# EasyEDA Pro project FOX_HTOL_1.0.eprj, board PCB1 (continued)
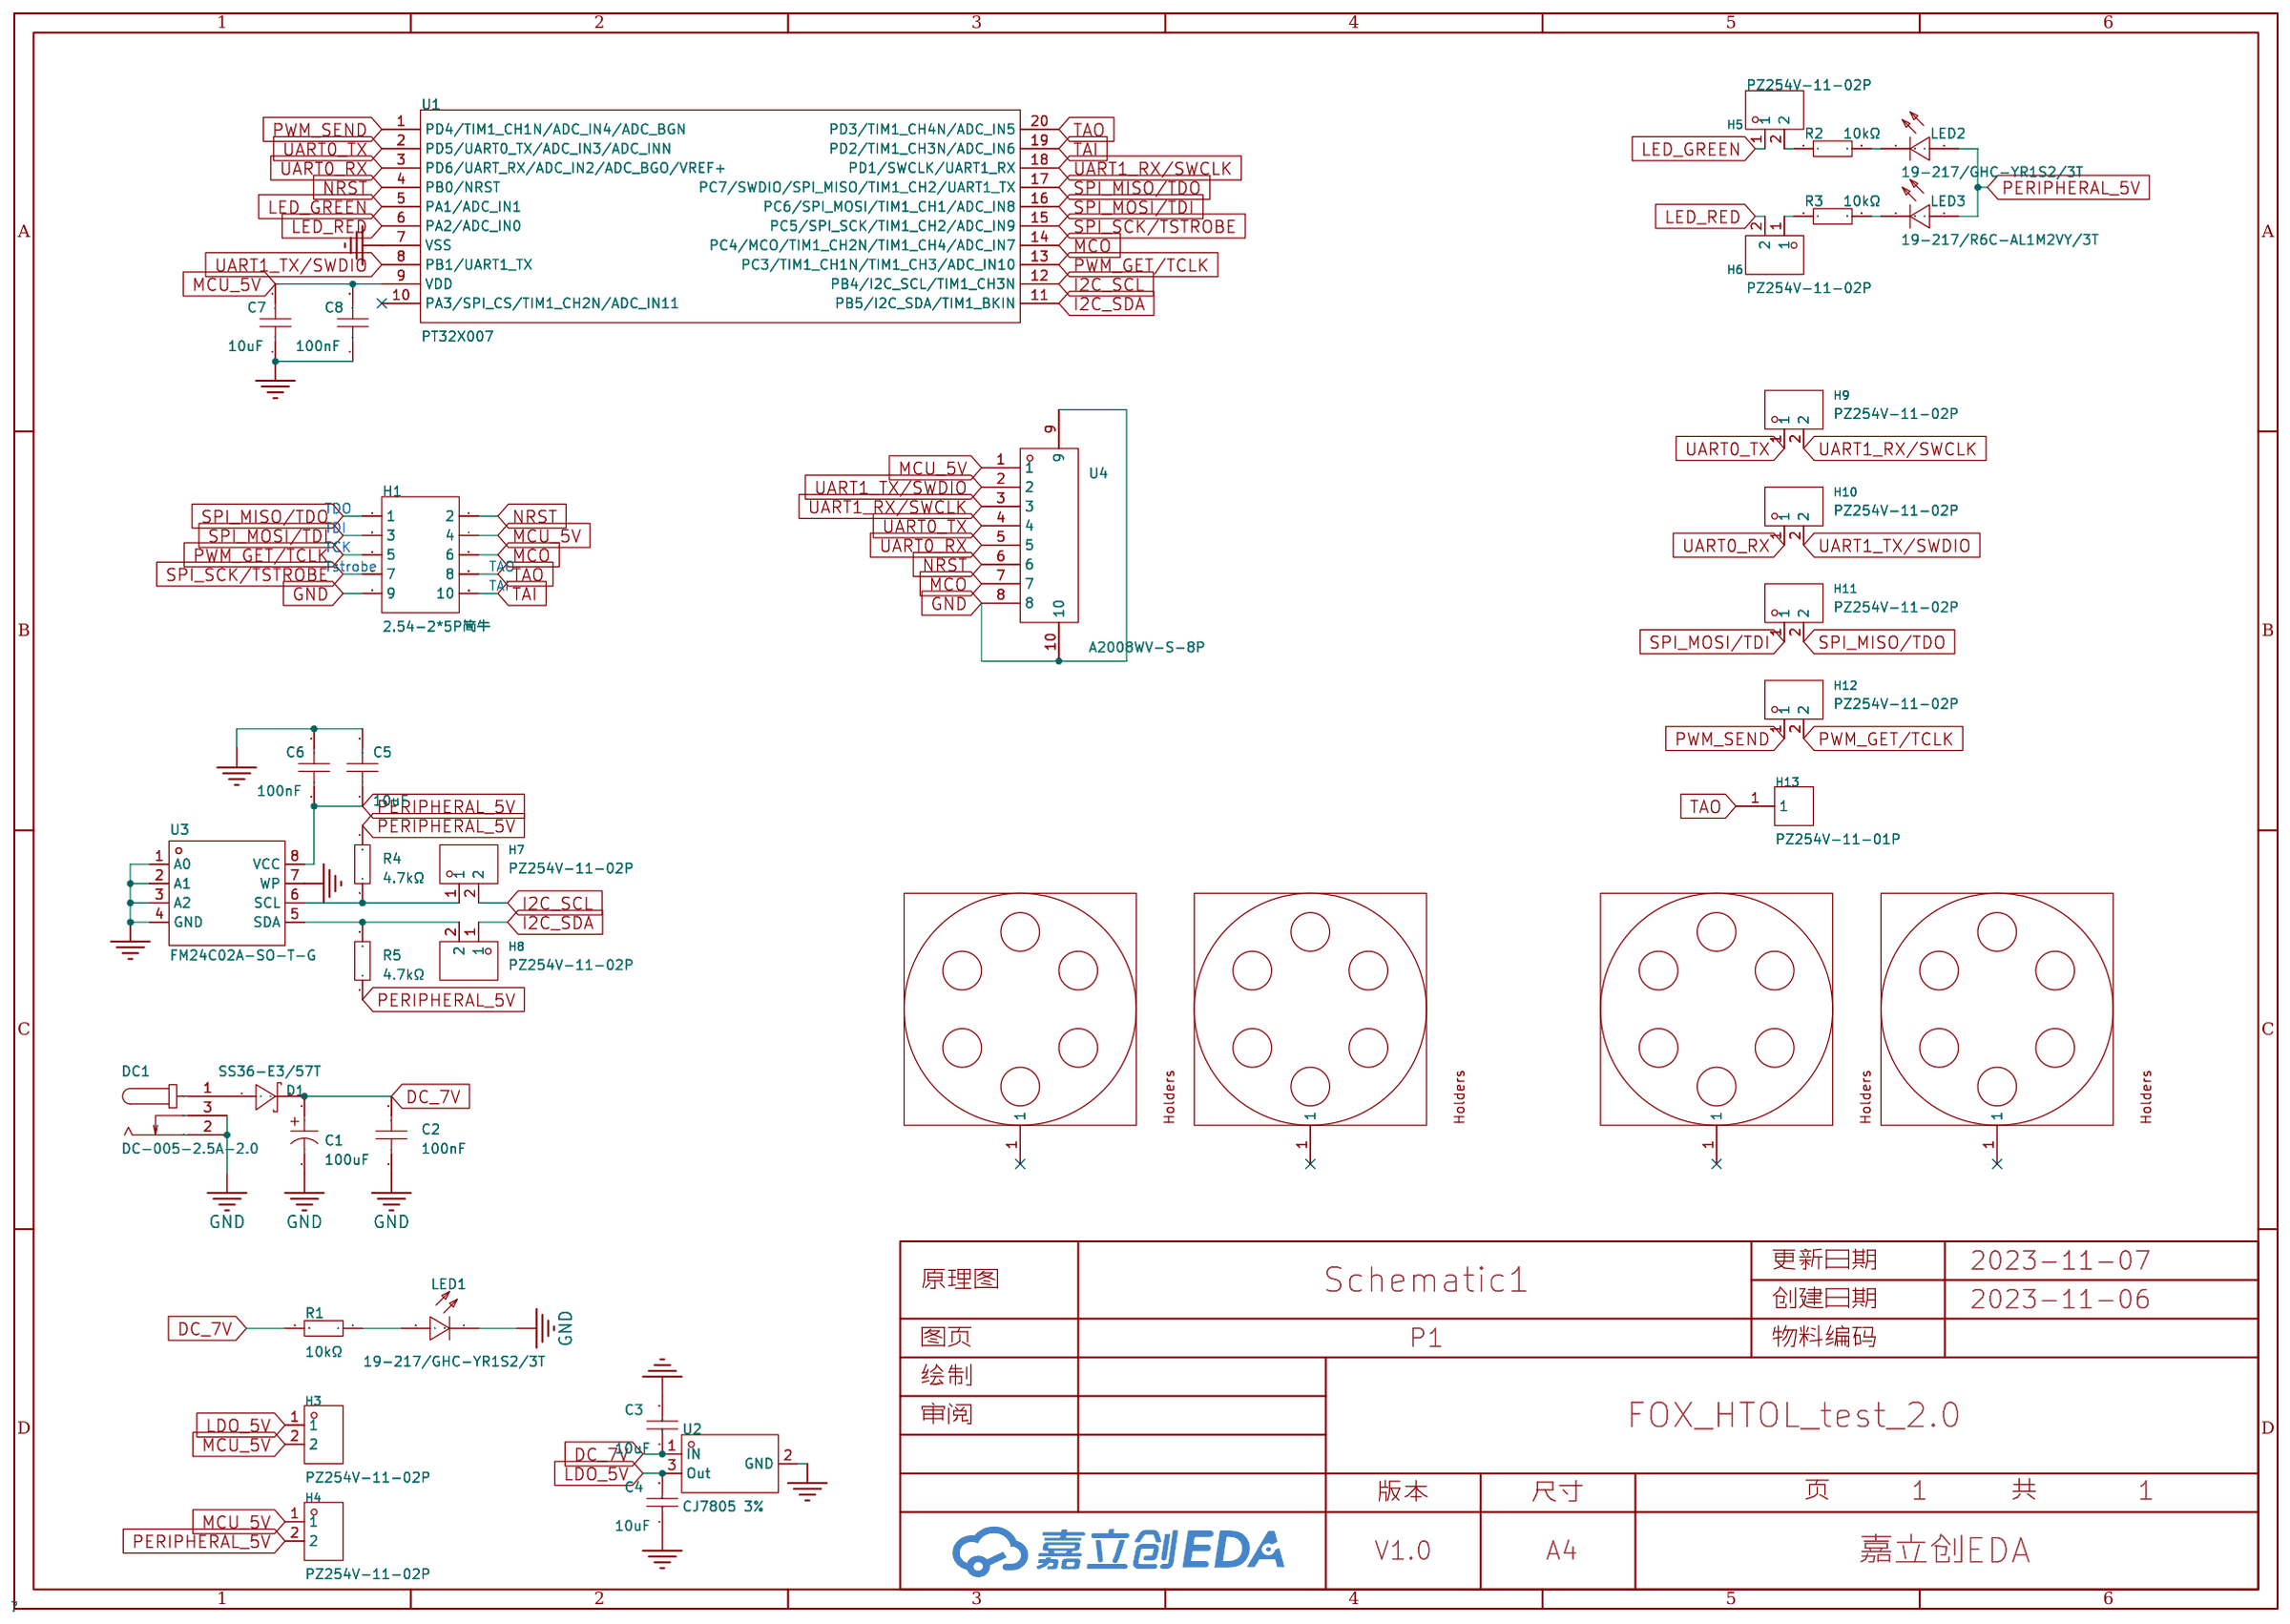
[diagram p0: schematic sheet]
## Routing (per net, layer and track width the routed paths; a pad name or vN(x,y) marks a point on that pad's centre or on a via; arc(x,y) is an arc through that point) (continued)
LED_RED: length 353.3
  Top Layer w0.254: U1#16.6 126.24,183.58 125.66,184.16 125.66,185.43 125.15,185.94 H6#14.2 ; H6#3.2 86.74,89.57 87.25,89.06 87.25,87.79 87.83,87.21 U1#6.6 ; U1#28.6 49.41,87.21 48.83,87.79 48.83,89.06 48.32,89.57 H6#25.2 ; H6#31.2 48.32,250.19 48.83,249.68 48.83,248.41 49.41,247.83 56.63,247.83 ; H6#4.2 86.74,218.07 87.25,217.56 87.25,216.29 87.83,215.71 U1#5.6 ; U1#18.6 10.99,151.46 10.41,152.04 10.41,153.31 9.91,153.82 H6#18.2 ; H6#23.2 48.32,121.69 48.83,121.18 48.83,119.91 49.41,119.33 56.63,119.33 ; U1#20.6 10.99,87.21 10.41,87.79 10.41,89.06 9.91,89.57 H6#20.2 ; 18.21,119.33 10.99,119.33 10.41,119.91 10.41,121.18 9.91,121.69 H6#22.2 ; H6#5.2 86.74,153.82 87.25,153.31 87.25,152.04 87.83,151.46 U1#9.6 ; H6#19.2 9.91,25.32 10.41,24.81 10.41,23.54 10.99,22.96 U1#19.6 ; U1#17.6 126.24,151.46 125.66,152.04 125.66,153.31 125.15,153.82 H6#13.2 ; H6#24.2 48.32,25.32 48.83,24.81 48.83,23.54 49.41,22.96 U1#26.6 ; 95.04,247.83 87.83,247.83 87.25,248.41 87.25,249.68 86.74,250.19 H6#8.2 ; H6#21.2 9.91,57.44 10.41,56.94 10.41,55.67 10.99,55.09 U1#21.6 ; U1#23.6 10.99,215.71 10.41,216.29 10.41,217.56 9.91,218.07 H6#26.2 ; U1#30.6 49.41,183.58 48.83,184.16 48.83,185.43 48.32,185.94 H6#29.2 ; U1#12.6 126.24,22.96 125.66,23.54 125.66,24.81 125.15,25.32 H6#10.2 ; U1#11.6 126.24,55.09 125.66,55.67 125.66,56.94 125.15,57.44 H6#15.2 ; U1#3.6 87.83,55.09 87.25,55.67 87.25,56.94 86.74,57.44 H6#7.2 ; U1#25.6 49.41,55.09 48.83,55.67 48.83,56.94 48.32,57.44 H6#30.2 ; U1#14.6 126.24,87.21 125.66,87.79 125.66,89.06 125.15,89.57 H6#11.2 ; 133.46,247.83 126.24,247.83 125.66,248.41 125.66,249.68 125.15,250.19 H6#16.2 ; H6#32.2 9.91,250.19 10.41,249.68 10.41,248.41 10.99,247.83 18.21,247.83 ; H6#12.2 125.15,218.07 125.66,217.56 125.66,216.29 126.24,215.71 U1#13.6 ; 95.04,119.33 87.83,119.33 87.25,119.91 87.25,121.18 86.74,121.69 H6.2 ; H6#27.2 48.32,218.07 48.83,217.56 48.83,216.29 49.41,215.71 U1#27.6 ; 133.46,119.33 126.24,119.33 125.66,119.91 125.66,121.18 125.15,121.69 H6#9.2 ; U1#4.6 87.83,22.96 87.25,23.54 87.25,24.81 86.74,25.32 H6#2.2 ; U1#31.6 10.99,183.58 10.41,184.16 10.41,185.43 9.91,185.94 H6#17.2 ; U1#32.6 49.41,151.46 48.83,152.04 48.83,153.31 48.32,153.82 H6#28.2 ; U1#8.6 87.83,183.58 87.25,184.16 87.25,185.43 86.74,185.94 H6#6.2
MCO: length 1673.7
  Top Layer w0.254: 62.37,247.18 63.65,247.18 v1(64.58,246.25) ; v1(64.58,214.13) 63.65,215.06 U1#27.14 ; v1(115.39,150.21) 115.34,150.26 115.31,150.26 ; U1#28.14 63.65,86.56 v1(64.58,85.63) ; U1#8.14 102.06,182.93 v1(102.99,182) ; v1(26.16,53.51) 25.23,54.44 U1#21.14 ; v1(26.16,21.38) 25.23,22.31 U1#19.14 ; U1#22.14 25.23,118.69 v1(26.16,117.76) ; U1#11.14 140.48,54.44 v1(141.41,53.51) ; v1(38.55,53.84) 38.51,53.89 38.48,53.89 ; 76.9,182.38 76.92,182.38 v1(76.97,182.34) ; 153.73,53.89 153.76,53.89 v1(153.8,53.84) ; v1(38.55,182.34) 38.51,182.38 38.48,182.38 ; U1#30.14 63.65,182.93 v1(64.58,182) ; 38.48,246.63 38.51,246.63 v1(38.55,246.59) ; v1(153.8,182.34) 153.76,182.38 153.73,182.38 ; U1#9.14 102.06,150.81 v1(102.99,149.88) ; U1#17.14 140.48,150.81 v1(141.41,149.88) ; 153.73,21.76 153.76,21.76 v1(153.8,21.72) ; v1(115.39,53.84) 115.34,53.89 115.31,53.89 ; 38.48,214.51 38.51,214.51 v1(38.55,214.46) ; v1(153.8,246.59) 153.76,246.63 153.73,246.63 ; 76.9,86.01 76.92,86.01 v1(76.97,85.96) ; v1(115.39,85.96) 115.34,86.01 115.31,86.01 ; 153.73,150.26 153.76,150.26 v1(153.8,150.21) ; U1#3.14 102.06,54.44 v1(102.99,53.51) ; U1#6.14 102.06,86.56 v1(102.99,85.63) ; v1(102.99,246.25) 102.06,247.18 100.78,247.18 ; v1(26.16,214.13) 25.23,215.06 U1#23.14 ; v1(141.41,182) 140.48,182.93 U1#16.14 ; 76.9,53.89 76.92,53.89 v1(76.97,53.84) ; 115.31,246.63 115.34,246.63 v1(115.39,246.59) ; v1(38.55,21.72) 38.51,21.76 38.48,21.76 ; v1(141.41,117.76) 140.48,118.69 U1#10.14 ; v1(76.97,214.46) 76.92,214.51 76.9,214.51 ; 76.9,118.14 76.92,118.14 v1(76.97,118.09) ; 153.73,86.01 153.76,86.01 v1(153.8,85.96) ; v1(64.58,21.38) 63.65,22.31 U1#26.14 ; 115.31,21.76 115.34,21.76 v1(115.39,21.72) ; U1#18.14 25.23,150.81 v1(26.16,149.88) ; v1(141.41,246.25) 140.48,247.18 139.2,247.18 ; v1(26.16,85.63) 25.23,86.56 U1#20.14 ; v1(153.8,118.09) 153.76,118.14 153.73,118.14 ; U1#13.14 140.48,215.06 v1(141.41,214.13) ; U1#25.14 63.65,54.44 v1(64.58,53.51) ; v1(76.97,150.21) 76.92,150.26 76.9,150.26 ; v1(76.97,21.72) 76.92,21.76 76.9,21.76 ; U1#12.14 140.48,22.31 v1(141.41,21.38) ; U1#4.14 102.06,22.31 v1(102.99,21.38) ; 23.95,247.18 25.23,247.18 v1(26.16,246.25) ; v1(153.8,214.46) 153.76,214.51 153.73,214.51 ; U1#5.14 102.06,215.06 v1(102.99,214.13) ; v1(141.41,85.63) 140.48,86.56 U1#14.14 ; U1#2.14 102.06,118.69 v1(102.99,117.76) ; U1#32.14 63.65,150.81 v1(64.58,149.88) ; v1(38.55,85.96) 38.51,86.01 38.48,86.01 ; v1(38.55,118.09) 38.51,118.14 38.48,118.14 ; U1#31.14 25.23,182.93 v1(26.16,182) ; 115.31,214.51 115.34,214.51 v1(115.39,214.46) ; 115.31,118.14 115.34,118.14 v1(115.39,118.09) ; 76.9,246.63 76.92,246.63 v1(76.97,246.59) ; v1(64.58,117.76) 63.65,118.69 U1#24.14 ; v1(38.55,150.21) 38.51,150.26 38.48,150.26 ; 115.31,182.38 115.34,182.38 v1(115.39,182.34)
  Bottom Layer w0.254: H1#27.6 63.82,230.64 76.64,230.64 78.55,228.73 78.55,214.89 78.12,214.46 v1(76.97,214.46) 76.92,214.51 70.8,214.51 70.42,214.13 v1(64.58,214.13) ; v1(141.41,149.88) 147.25,149.88 147.63,150.26 153.76,150.26 v1(153.8,150.21) 154.95,150.21 155.38,150.64 155.38,164.48 153.47,166.39 140.65,166.39 H1#14.6 ; v1(141.41,85.63) 147.25,85.63 147.63,86.01 153.76,86.01 v1(153.8,85.96) 154.95,85.96 155.38,86.39 155.38,100.24 153.47,102.14 140.65,102.14 H1#15.6 ; v1(64.58,21.38) 70.42,21.38 70.8,21.76 76.92,21.76 v1(76.97,21.72) 78.12,21.72 78.55,22.14 78.55,35.99 76.64,37.89 63.82,37.89 H1#23.6 ; 59.62,194.32 63.82,198.51 76.64,198.51 78.55,196.61 78.55,182.77 78.12,182.34 v1(76.97,182.34) 76.92,182.38 70.8,182.38 70.42,182 v1(64.58,182) ; v1(64.58,246.25) 70.42,246.25 70.8,246.63 76.92,246.63 v1(76.97,246.59) 78.12,246.59 78.55,247.01 78.55,260.86 76.64,262.76 63.82,262.76 H1#26.6 ; H1#8.6 140.65,70.02 153.47,70.02 155.38,68.11 155.38,54.27 154.95,53.84 v1(153.8,53.84) 153.76,53.89 147.63,53.89 147.25,53.51 v1(141.41,53.51) ; H1#3.6 102.23,134.27 115.06,134.27 116.96,132.36 116.96,118.52 116.54,118.09 v1(115.39,118.09) 115.34,118.14 109.22,118.14 108.84,117.76 v1(102.99,117.76) ; v1(141.41,246.25) 147.25,246.25 147.63,246.63 153.76,246.63 v1(153.8,246.59) 154.95,246.59 155.38,247.01 155.38,260.86 153.47,262.76 140.65,262.76 H1#11.6 ; v1(64.58,85.63) 70.42,85.63 70.8,86.01 76.92,86.01 v1(76.97,85.96) 78.12,85.96 78.55,86.39 78.55,100.24 76.64,102.14 63.82,102.14 H1#30.6 ; H1#17.6 25.4,37.89 38.23,37.89 40.13,35.99 40.13,22.14 39.7,21.72 v1(38.55,21.72) 38.51,21.76 32.39,21.76 32,21.38 v1(26.16,21.38) ; v1(26.16,182) 32,182 32.39,182.38 38.51,182.38 v1(38.55,182.34) 39.7,182.34 40.13,182.77 40.13,196.61 38.23,198.51 25.4,198.51 21.21,194.32 ; H1.6 102.23,102.14 115.06,102.14 116.96,100.24 116.96,86.39 116.54,85.96 v1(115.39,85.96) 115.34,86.01 109.22,86.01 108.84,85.63 v1(102.99,85.63) ; v1(26.16,85.63) 32,85.63 32.39,86.01 38.51,86.01 v1(38.55,85.96) 39.7,85.96 40.13,86.39 40.13,100.24 38.23,102.14 25.4,102.14 H1#18.6 ; H1#22.6 63.82,70.02 76.64,70.02 78.55,68.11 78.55,54.27 78.12,53.84 v1(76.97,53.84) 76.92,53.89 70.8,53.89 70.42,53.51 v1(64.58,53.51) ; H1#29.6 63.82,166.39 76.64,166.39 78.55,164.48 78.55,150.64 78.12,150.21 v1(76.97,150.21) 76.92,150.26 70.8,150.26 70.42,149.88 v1(64.58,149.88) ; H1#10.6 140.65,134.27 153.47,134.27 155.38,132.36 155.38,118.52 154.95,118.09 v1(153.8,118.09) 153.76,118.14 147.63,118.14 147.25,117.76 v1(141.41,117.76) ; H1#25.6 25.4,262.76 38.23,262.76 40.13,260.86 40.13,247.01 39.7,246.59 v1(38.55,246.59) 38.51,246.63 32.39,246.63 32,246.25 v1(26.16,246.25) ; H1#19.6 25.4,70.02 38.23,70.02 40.13,68.11 40.13,54.27 39.7,53.84 v1(38.55,53.84) 38.51,53.89 32.39,53.89 32,53.51 v1(26.16,53.51) ; v1(102.99,21.38) 108.84,21.38 109.22,21.76 115.34,21.76 v1(115.39,21.72) 116.54,21.72 116.96,22.14 116.96,35.99 115.06,37.89 102.23,37.89 H1#2.6 ; v1(102.99,149.88) 108.84,149.88 109.22,150.26 115.34,150.26 v1(115.39,150.21) 116.54,150.21 116.96,150.64 116.96,164.48 115.06,166.39 102.23,166.39 H1#7.6 ; H1#4.6 102.23,262.76 115.06,262.76 116.96,260.86 116.96,247.01 116.54,246.59 v1(115.39,246.59) 115.34,246.63 109.22,246.63 108.84,246.25 v1(102.99,246.25) ; v1(102.99,214.13) 108.84,214.13 109.22,214.51 115.34,214.51 v1(115.39,214.46) 116.54,214.46 116.96,214.89 116.96,228.73 115.06,230.64 102.23,230.64 H1#5.6 ; v1(64.58,117.76) 70.42,117.76 70.8,118.14 76.92,118.14 v1(76.97,118.09) 78.12,118.09 78.55,118.52 78.55,132.36 76.64,134.27 63.82,134.27 H1#24.6 ; H1#9.6 140.65,37.89 153.47,37.89 155.38,35.99 155.38,22.14 154.95,21.72 v1(153.8,21.72) 153.76,21.76 147.63,21.76 147.25,21.38 v1(141.41,21.38) ; v1(26.16,214.13) 32,214.13 32.39,214.51 38.51,214.51 v1(38.55,214.46) 39.7,214.46 40.13,214.89 40.13,228.73 38.23,230.64 25.4,230.64 H1#21.6 ; 98.04,194.32 102.23,198.51 115.06,198.51 116.96,196.61 116.96,182.77 116.54,182.34 v1(115.39,182.34) 115.34,182.38 109.22,182.38 108.84,182 v1(102.99,182) ; v1(141.41,214.13) 147.25,214.13 147.63,214.51 153.76,214.51 v1(153.8,214.46) 154.95,214.46 155.38,214.89 155.38,228.73 153.47,230.64 140.65,230.64 H1#12.6 ; 136.46,194.32 140.65,198.51 153.47,198.51 155.38,196.61 155.38,182.77 154.95,182.34 v1(153.8,182.34) 153.76,182.38 147.63,182.38 147.25,182 v1(141.41,182) ; H1#16.6 25.4,166.39 38.23,166.39 40.13,164.48 40.13,150.64 39.7,150.21 v1(38.55,150.21) 38.51,150.26 32.39,150.26 32,149.88 v1(26.16,149.88) ; H1#20.6 25.4,134.27 38.23,134.27 40.13,132.36 40.13,118.52 39.7,118.09 v1(38.55,118.09) 38.51,118.14 32.39,118.14 32,117.76 v1(26.16,117.76) ; H1#32.6 102.23,70.02 115.06,70.02 116.96,68.11 116.96,54.27 116.54,53.84 v1(115.39,53.84) 115.34,53.89 109.22,53.89 108.84,53.51 v1(102.99,53.51)
MCU_5V: length 2374.2
  Top Layer w0.254: C7#32.2 C8#29.2 55.38,181.43 55.58,181.63 U1#30.9 ; C7#6.2 C8#9.2 93.79,149.31 93.99,149.51 U1#9.9 ; U1#31.9 17.16,181.63 16.96,181.43 C8#7.2 C7#8.2 ; C7#29.2 C8#31.2 55.38,245.68 55.58,245.88 U1#29.9 ; C7#31.2 C8#30.2 55.38,85.06 55.58,85.26 56.63,85.26 ; C7#2.2 C8#2.2 93.79,20.81 93.99,21.01 U1#4.9 ; U1#13.9 132.41,213.76 132.21,213.56 C8#13.2 C7#12.2 ; C7#27.2 C8#28.2 55.38,213.56 55.58,213.76 U1#27.9 ; 133.46,85.26 132.41,85.26 132.21,85.06 C8#15.2 C7#16.2 ; U1.9 17.16,245.88 16.96,245.68 C8#19.2 C7#19.2 ; C7#21.2 C8#22.2 16.96,20.81 17.16,21.01 U1#19.9 ; C7#24.2 C8#24.2 16.96,213.56 17.16,213.76 U1#23.9 ; U1#25.9 55.58,53.14 55.38,52.93 C8#27.2 C7#28.2 ; U1#2.9 93.99,117.39 93.79,117.18 C8.2 C7.2 ; U1#18.9 17.16,149.51 16.96,149.31 C8#18.2 C7#18.2 ; U1#32.9 55.58,149.51 55.38,149.31 C8#32.2 C7#30.2 ; C7#7.2 C8#6.2 93.79,85.06 93.99,85.26 95.04,85.26 ; C7#15.2 C8#17.2 132.21,149.31 132.41,149.51 U1#17.9 ; 18.21,85.26 17.16,85.26 16.96,85.06 C8#20.2 C7#20.2 ; U1#22.9 17.16,117.39 16.96,117.18 C8#23.2 C7#23.2 ; C7#4.2 C8#3.2 93.79,52.93 93.99,53.14 U1#3.9 ; C7#14.2 C8#16.2 132.21,245.68 132.41,245.88 U1#15.9 ; U1#7.9 93.99,245.88 93.79,245.68 C8#8.2 C7#5.2 ; U1#26.9 55.58,21.01 55.38,20.81 C8#26.2 C7#26.2 ; C7#9.2 C8#5.2 93.79,181.43 93.99,181.63 U1#8.9 ; C7#25.2 C8#25.2 55.38,117.18 55.58,117.39 U1#24.9 ; U1#16.9 132.41,181.63 132.21,181.43 C8#14.2 C7#17.2 ; C7#13.2 C8#12.2 132.21,52.93 132.41,53.14 U1#11.9 ; C7#10.2 C8#10.2 132.21,117.18 132.41,117.39 U1#10.9 ; C7#22.2 C8#21.2 16.96,52.93 17.16,53.14 U1#21.9 ; C7#3.2 C8#4.2 93.79,213.56 93.99,213.76 U1#5.9 ; U1#12.9 132.41,21.01 132.21,20.81 C8#11.2 C7#11.2
  Top Layer w0.5: U4#11.1 147.71,65.84 146.32,67.22 135.31,67.22 H1#8.4 ; H1#30.4 58.48,99.35 69.49,99.35 70.87,97.96 U4#24.1 ; U4#19.1 32.46,162.21 31.08,163.6 20.07,163.6 H1#16.4 ; U4#8.1 109.29,130.09 107.91,131.47 96.9,131.47 H1#3.4 ; U4#32.1 70.87,130.09 69.49,131.47 58.48,131.47 H1#24.4 ; H4#12.1 124.65,151.28 125.92,150.01 v3(127.06,150.01) 127.76,149.31 C7#15.2 ; U4#22.1 32.46,97.96 31.08,99.35 20.07,99.35 H1#18.4 ; C7#16.2 127.76,85.06 v3(127.06,85.76) 125.92,85.76 124.65,87.03 H4#15.1 ; U4#27.1 70.87,194.34 69.49,195.72 58.48,195.72 57.09,194.32 ; H1#11.4 135.31,259.97 146.32,259.97 147.71,258.59 U4#15.1 ; H4#32.1 9.4,247.65 10.67,246.38 v3(11.81,246.38) 12.51,245.68 C7#19.2 ; H4#13.1 124.65,54.9 125.92,53.63 v3(127.06,53.63) 127.76,52.93 C7#13.2 ; H4#4.1 86.23,151.28 87.5,150.01 v3(88.64,150.01) 89.34,149.31 C7#6.2 ; H4#2.1 86.23,22.78 87.5,21.51 v3(88.64,21.51) 89.34,20.81 C7#2.2 ; H1#26.4 58.48,259.97 69.49,259.97 70.87,258.59 U4#29.1 ; H1#32.4 96.9,67.22 107.91,67.22 109.29,65.84 U4#2.1 ; C7#30.2 50.93,149.31 v3(50.23,150.01) 49.08,150.01 47.81,151.28 H4#27.1 ; C7#14.2 127.76,245.68 v3(127.06,246.38) 125.92,246.38 124.65,247.65 H4#16.1 ; C7#22.2 12.51,52.93 v3(11.81,53.63) 10.67,53.63 9.4,54.9 H4#21.1 ; H4#7.1 86.23,87.03 87.5,85.76 v3(88.64,85.76) 89.34,85.06 C7#7.2 ; H4#10.1 124.65,22.78 125.92,21.51 v3(127.06,21.51) 127.76,20.81 C7#11.2 ; H1#23.4 58.48,35.1 69.49,35.1 70.87,33.72 U4#26.1 ; H1#10.4 135.31,131.47 146.32,131.47 147.71,130.09 U4#17.1 ; H4#18.1 9.4,151.28 10.67,150.01 v3(11.81,150.01) 12.51,149.31 C7#18.2 ; H1#14.4 135.31,163.6 146.32,163.6 147.71,162.21 U4#14.1 ; H1#19.4 20.07,67.22 31.08,67.22 32.46,65.84 U4#21.1 ; U4#30.1 70.87,226.46 69.49,227.84 58.48,227.84 H1#27.4 ; U4#5.1 109.29,162.21 107.91,163.6 96.9,163.6 H1#7.4 ; H4#19.1 9.4,22.78 10.67,21.51 v3(11.81,21.51) 12.51,20.81 C7#21.2 ; 95.5,194.32 96.9,195.72 107.91,195.72 109.29,194.34 U4#4.1 ; C7#23.2 12.51,117.18 v3(11.81,117.88) 10.67,117.88 9.4,119.15 H4#22.1 ; U4#6.1 109.29,258.59 107.91,259.97 96.9,259.97 H1#4.4 ; C7#10.2 127.76,117.18 v3(127.06,117.88) 125.92,117.88 124.65,119.15 H4#9.1 ; H4#5.1 86.23,54.9 87.5,53.63 v3(88.64,53.63) 89.34,52.93 C7#4.2 ; H1#15.4 135.31,99.35 146.32,99.35 147.71,97.96 U4#10.1 ; C7#12.2 127.76,213.56 v3(127.06,214.26) 125.92,214.26 124.65,215.53 H4#11.1 ; H4#17.1 9.4,183.4 10.67,182.13 v3(11.81,182.13) 12.51,181.43 C7#8.2 ; U4.1 109.29,97.96 107.91,99.35 96.9,99.35 H1.4 ; C7#20.2 12.51,85.06 v3(11.81,85.76) 10.67,85.76 9.4,87.03 H4#20.1 ; U4#9.1 32.46,258.59 31.08,259.97 20.07,259.97 H1#25.4 ; H1#12.4 135.31,227.84 146.32,227.84 147.71,226.46 U4#16.1 ; C7#5.2 89.34,245.68 v3(88.64,246.38) 87.5,246.38 86.23,247.65 H4#8.1 ; 133.92,194.32 135.31,195.72 146.32,195.72 147.71,194.34 U4#13.1 ; U4#28.1 70.87,162.21 69.49,163.6 58.48,163.6 H1#29.4 ; C7#27.2 50.93,213.56 v3(50.23,214.26) 49.08,214.26 47.81,215.53 H4#26.1 ; U4#18.1 32.46,194.34 31.08,195.72 20.07,195.72 18.67,194.32 ; C7#26.2 50.93,20.81 v3(50.23,21.51) 49.08,21.51 47.81,22.78 H4#24.1 ; C7#17.2 127.76,181.43 v3(127.06,182.13) 125.92,182.13 124.65,183.4 H4#14.1 ; U4#3.1 109.29,33.72 107.91,35.1 96.9,35.1 H1#2.4 ; H4#3.1 86.23,215.53 87.5,214.26 v3(88.64,214.26) 89.34,213.56 C7#3.2 ; U4#12.1 147.71,33.72 146.32,35.1 135.31,35.1 H1#9.4 ; H4.1 86.23,119.15 87.5,117.88 v3(88.64,117.88) 89.34,117.18 C7.2 ; C7#31.2 50.93,85.06 v3(50.23,85.76) 49.08,85.76 47.81,87.03 H4#30.1 ; U4#31.1 32.46,226.46 31.08,227.84 20.07,227.84 H1#21.4 ; C7#32.2 50.93,181.43 v3(50.23,182.13) 49.08,182.13 47.81,183.4 H4#29.1 ; H4#28.1 47.81,54.9 49.08,53.63 v3(50.23,53.63) 50.93,52.93 C7#28.2 ; H1#5.4 96.9,227.84 107.91,227.84 109.29,226.46 U4#7.1 ; H4#25.1 9.4,215.53 10.67,214.26 v3(11.81,214.26) 12.51,213.56 C7#24.2 ; U4#25.1 70.87,65.84 69.49,67.22 58.48,67.22 H1#22.4 ; C7#29.2 50.93,245.68 v3(50.23,246.38) 49.08,246.38 47.81,247.65 H4#31.1 ; C7#25.2 50.93,117.18 v3(50.23,117.88) 49.08,117.88 47.81,119.15 H4#23.1 ; H4#6.1 86.23,183.4 87.5,182.13 v3(88.64,182.13) 89.34,181.43 C7#9.2 ; H1#17.4 20.07,35.1 31.08,35.1 32.46,33.72 U4#20.1 ; U4#23.1 32.46,130.09 31.08,131.47 20.07,131.47 H1#20.4
  Bottom Layer w0.5: 57.09,194.32 55.69,195.72 51.5,195.72 50.23,194.45 v3(50.23,182.13) ; v3(88.64,150.01) 88.64,162.33 89.91,163.6 94.1,163.6 H1#7.4 ; H1#22.4 55.69,67.22 51.5,67.22 50.23,65.95 v3(50.23,53.63) ; v3(11.81,53.63) 11.81,65.95 13.08,67.22 17.27,67.22 H1#19.4 ; 133.92,194.32 132.52,195.72 128.33,195.72 127.06,194.45 v3(127.06,182.13) ; v3(127.06,214.26) 127.06,226.57 128.33,227.84 132.52,227.84 H1#12.4 ; v3(88.64,182.13) 88.64,194.45 89.91,195.72 94.1,195.72 95.5,194.32 ; H1#9.4 132.52,35.1 128.33,35.1 127.06,33.83 v3(127.06,21.51) ; v3(50.23,246.38) 50.23,258.7 51.5,259.97 55.69,259.97 H1#26.4 ; v3(127.06,117.88) 127.06,130.2 128.33,131.47 132.52,131.47 H1#10.4 ; v3(50.23,150.01) 50.23,162.33 51.5,163.6 55.69,163.6 H1#29.4 ; H1#8.4 132.52,67.22 128.33,67.22 127.06,65.95 v3(127.06,53.63) ; v3(127.06,246.38) 127.06,258.7 128.33,259.97 132.52,259.97 H1#11.4 ; v3(11.81,246.38) 11.81,258.7 13.08,259.97 17.27,259.97 H1#25.4 ; v3(88.64,246.38) 88.64,258.7 89.91,259.97 94.1,259.97 H1#4.4 ; v3(50.23,85.76) 50.23,98.08 51.5,99.35 55.69,99.35 H1#30.4 ; v3(127.06,85.76) 127.06,98.08 128.33,99.35 132.52,99.35 H1#15.4 ; v3(11.81,85.76) 11.81,98.08 13.08,99.35 17.27,99.35 H1#18.4 ; H1#14.4 132.52,163.6 128.33,163.6 127.06,162.33 v3(127.06,150.01) ; v3(50.23,117.88) 50.23,130.2 51.5,131.47 55.69,131.47 H1#24.4 ; v3(88.64,21.51) 88.64,33.83 89.91,35.1 94.1,35.1 H1#2.4 ; H1#23.4 55.69,35.1 51.5,35.1 50.23,33.83 v3(50.23,21.51) ; H1.4 94.1,99.35 89.91,99.35 88.64,98.08 v3(88.64,85.76) ; H1#32.4 94.1,67.22 89.91,67.22 88.64,65.95 v3(88.64,53.63) ; v3(88.64,214.26) 88.64,226.57 89.91,227.84 94.1,227.84 H1#5.4 ; v3(11.81,117.88) 11.81,130.2 13.08,131.47 17.27,131.47 H1#20.4 ; v3(50.23,214.26) 50.23,226.57 51.5,227.84 55.69,227.84 H1#27.4 ; H1#16.4 17.27,163.6 13.08,163.6 11.81,162.33 v3(11.81,150.01) ; H1#3.4 94.1,131.47 89.91,131.47 88.64,130.2 v3(88.64,117.88) ; H1#17.4 17.27,35.1 13.08,35.1 11.81,33.83 v3(11.81,21.51) ; 18.67,194.32 17.27,195.72 13.08,195.72 11.81,194.45 v3(11.81,182.13) ; H1#21.4 17.27,227.84 13.08,227.84 11.81,226.57 v3(11.81,214.26)
  Bottom Layer w1: H1#8.4 133.92,68.77 136.65,71.5 154.31,71.5 159.89,77.09 159.89,264.29 156.21,267.97 83.18,267.97 81.04,270.11 H3#3.2 ; 18.67,194.32 18.67,198.37 16.51,200.53 5.97,200.53 1.65,204.85 1.65,263.78 6.22,268.35 35.31,268.35 36.75,269.79 H3#4.2 ; H1#10.4 133.92,133.03 136.78,135.89 154.69,135.89 157.86,139.06 157.86,262.64 154.94,265.56 69.98,265.56 66.3,269.23 H3#2.2 ; H3.2 51.57,268.36 48.64,265.43 21.84,265.43 18.67,262.25 H1#25.4
NRST: length 1193.3
  Top Layer w0.254: v1(53.28,217.01) U1#27.4 57.46,217.01 57.78,216.69 57.78,215.34 v2(58.1,215.02) ; v1(14.86,249.13) 19.04,249.13 19.36,248.81 19.36,247.47 v2(19.69,247.14) ; v1(115.39,87.96) 115.43,87.92 115.44,87.92 ; v2(96.52,22.27) 96.19,22.59 96.19,23.94 95.87,24.26 U1#4.4 v1(91.69,24.26) ; v1(153.8,55.84) 153.85,55.79 153.86,55.79 ; v1(76.97,120.09) 77.02,120.04 77.02,120.04 ; v1(91.69,152.76) U1#9.4 95.87,152.76 96.19,152.44 96.19,151.09 v2(96.52,150.77) ; v1(53.28,88.51) U1#28.4 57.46,88.51 57.78,88.19 57.78,86.84 v2(58.1,86.52) ; v2(19.69,22.27) 19.36,22.59 19.36,23.94 19.04,24.26 U1#19.4 v1(14.86,24.26) ; v1(91.69,249.13) 95.87,249.13 96.19,248.81 96.19,247.47 v2(96.52,247.14) ; v2(58.1,247.14) 57.78,247.47 57.78,248.81 57.46,249.13 v1(53.28,249.13) ; v1(115.39,152.21) 115.43,152.17 115.44,152.17 ; v1(130.11,249.13) 134.29,249.13 134.61,248.81 134.61,247.47 v2(134.93,247.14) ; v1(130.11,120.64) U1#10.4 134.29,120.64 134.61,120.31 134.61,118.97 v2(134.93,118.64) ; v1(153.8,184.34) 153.85,184.29 153.86,184.29 ; v1(115.39,55.84) 115.43,55.79 115.44,55.79 ; v2(134.93,150.77) 134.61,151.09 134.61,152.44 134.29,152.76 U1#17.4 v1(130.11,152.76) ; 77.02,55.79 77.02,55.79 v1(76.97,55.84) ; v1(130.11,217.01) U1#13.4 134.29,217.01 134.61,216.69 134.61,215.34 v2(134.93,215.02) ; v1(38.55,152.21) 38.6,152.17 38.61,152.17 ; 115.44,184.29 115.43,184.29 v1(115.39,184.34) ; 38.61,87.92 38.6,87.92 v1(38.55,87.96) ; v1(38.55,55.84) 38.6,55.79 38.61,55.79 ; v1(153.8,248.59) 153.85,248.54 153.86,248.54 ; 115.44,216.41 115.43,216.41 v1(115.39,216.46) ; v2(19.69,150.77) 19.36,151.09 19.36,152.44 19.04,152.76 U1#18.4 v1(14.86,152.76) ; v2(58.1,22.27) 57.78,22.59 57.78,23.94 57.46,24.26 U1#26.4 v1(53.28,24.26) ; v1(130.11,56.39) U1#11.4 134.29,56.39 134.61,56.07 134.61,54.72 v2(134.93,54.4) ; v1(53.28,184.88) U1#30.4 57.46,184.88 57.78,184.56 57.78,183.22 v2(58.1,182.89) ; 38.61,248.54 38.6,248.54 v1(38.55,248.59) ; v1(153.8,120.09) 153.85,120.04 153.86,120.04 ; 38.61,216.41 38.6,216.41 v1(38.55,216.46) ; v1(91.69,184.88) U1#8.4 95.87,184.88 96.19,184.56 96.19,183.22 v2(96.52,182.89) ; v1(130.11,88.51) U1#14.4 134.29,88.51 134.61,88.19 134.61,86.84 v2(134.93,86.52) ; v1(76.97,216.46) 77.02,216.41 77.02,216.41 ; v1(130.11,184.88) U1#16.4 134.29,184.88 134.61,184.56 134.61,183.22 v2(134.93,182.89) ; v1(76.97,23.72) 77.02,23.67 77.02,23.67 ; v1(14.86,56.39) U1#21.4 19.04,56.39 19.36,56.07 19.36,54.72 v2(19.69,54.4) ; v2(134.93,22.27) 134.61,22.59 134.61,23.94 134.29,24.26 U1#12.4 v1(130.11,24.26) ; 153.86,152.17 153.85,152.17 v1(153.8,152.21) ; v1(38.55,120.09) 38.6,120.04 38.61,120.04 ; 115.44,120.04 115.43,120.04 v1(115.39,120.09) ; v1(91.69,120.64) U1#2.4 95.87,120.64 96.19,120.31 96.19,118.97 v2(96.52,118.64) ; v1(14.86,184.88) U1#31.4 19.04,184.88 19.36,184.56 19.36,183.22 v2(19.69,182.89) ; v1(76.97,87.96) 77.02,87.92 77.02,87.92 ; v1(153.8,216.46) 153.85,216.41 153.86,216.41 ; 115.44,23.67 115.43,23.67 v1(115.39,23.72) ; v2(58.1,118.64) 57.78,118.97 57.78,120.31 57.46,120.64 U1#24.4 v1(53.28,120.64) ; v1(76.97,184.34) 77.02,184.29 77.02,184.29 ; v1(91.69,88.51) U1#6.4 95.87,88.51 96.19,88.19 96.19,86.84 v2(96.52,86.52) ; v2(96.52,215.02) 96.19,215.34 96.19,216.69 95.87,217.01 U1#5.4 v1(91.69,217.01) ; v1(76.97,152.21) 77.02,152.17 77.02,152.17 ; v1(91.69,56.39) U1#3.4 95.87,56.39 96.19,56.07 96.19,54.72 v2(96.52,54.4) ; v2(58.1,150.77) 57.78,151.09 57.78,152.44 57.46,152.76 U1#32.4 v1(53.28,152.76) ; v1(76.97,248.59) 77.02,248.54 77.02,248.54 ; v1(38.55,23.72) 38.6,23.67 38.61,23.67 ; v2(19.69,86.52) 19.36,86.84 19.36,88.19 19.04,88.51 U1#20.4 v1(14.86,88.51) ; v1(14.86,217.01) U1#23.4 19.04,217.01 19.36,216.69 19.36,215.34 v2(19.69,215.02) ; v2(58.1,54.4) 57.78,54.72 57.78,56.07 57.46,56.39 U1#25.4 v1(53.28,56.39) ; v1(38.55,184.34) 38.6,184.29 38.61,184.29 ; 153.86,23.67 153.85,23.67 v1(153.8,23.72) ; v2(19.69,118.64) 19.36,118.97 19.36,120.31 19.04,120.64 U1#22.4 v1(14.86,120.64) ; 115.44,248.54 115.43,248.54 v1(115.39,248.59) ; 153.86,87.92 153.85,87.92 v1(153.8,87.96)
  Bottom Layer w0.254: v2(96.52,215.02) 109.09,215.02 110.53,216.46 v1(115.39,216.46) ; H1#3.2 91.56,130.07 91.06,129.57 91.06,121.31 91.69,120.68 v1(91.69,120.64) ; v2(58.1,150.77) 70.67,150.77 72.12,152.21 v1(76.97,152.21) ; v1(153.8,216.46) 148.95,216.46 147.51,215.02 v2(134.93,215.02) ; v1(91.69,88.51) 91.69,88.55 91.06,89.19 91.06,97.44 91.56,97.95 H1.2 ; H1#7.2 91.56,162.2 91.06,161.69 91.06,153.44 91.69,152.8 v1(91.69,152.76) ; v1(130.11,120.64) 130.11,120.68 129.47,121.31 129.47,129.57 129.98,130.07 H1#10.2 ; v1(53.28,249.13) 53.28,249.17 52.64,249.81 52.64,258.06 53.15,258.57 H1#26.2 ; v1(153.8,55.84) 148.95,55.84 147.51,54.4 v2(134.93,54.4) ; v2(96.52,86.52) 109.09,86.52 110.53,87.96 v1(115.39,87.96) ; H1#19.2 14.73,65.83 14.22,65.32 14.22,57.06 14.86,56.43 v1(14.86,56.39) ; H1#24.2 53.15,130.07 52.64,129.57 52.64,121.31 53.28,120.68 v1(53.28,120.64) ; v1(130.11,184.88) 130.11,184.92 129.47,185.56 129.47,193.81 129.98,194.32 131.38,194.32 ; v2(19.69,54.4) 32.26,54.4 33.7,55.84 v1(38.55,55.84) ; v1(14.86,120.64) 14.86,120.68 14.22,121.31 14.22,129.57 14.73,130.07 H1#20.2 ; v1(91.69,56.39) 91.69,56.43 91.06,57.06 91.06,65.32 91.56,65.83 H1#32.2 ; H1#8.2 129.98,65.83 129.47,65.32 129.47,57.06 130.11,56.43 v1(130.11,56.39) ; v1(76.97,87.96) 72.12,87.96 70.67,86.52 v2(58.1,86.52) ; v1(115.39,23.72) 110.53,23.72 109.09,22.27 v2(96.52,22.27) ; 92.96,194.32 91.56,194.32 91.06,193.81 91.06,185.56 91.69,184.92 v1(91.69,184.88) ; v1(91.69,249.13) 91.69,249.17 91.06,249.81 91.06,258.06 91.56,258.57 H1#4.2 ; v2(96.52,54.4) 109.09,54.4 110.53,55.84 v1(115.39,55.84) ; v1(130.11,249.13) 130.11,249.17 129.47,249.81 129.47,258.06 129.98,258.57 H1#11.2 ; v1(76.97,216.46) 72.12,216.46 70.67,215.02 v2(58.1,215.02) ; v1(76.97,184.34) 72.12,184.34 70.67,182.89 v2(58.1,182.89) ; v1(115.39,184.34) 110.53,184.34 109.09,182.89 v2(96.52,182.89) ; v1(38.55,23.72) 33.7,23.72 32.26,22.27 v2(19.69,22.27) ; v1(130.11,152.76) 130.11,152.8 129.47,153.44 129.47,161.69 129.98,162.2 H1#14.2 ; v1(115.39,152.21) 110.53,152.21 109.09,150.77 v2(96.52,150.77) ; v2(19.69,247.14) 32.26,247.14 33.7,248.59 v1(38.55,248.59) ; v1(53.28,152.76) 53.28,152.8 52.64,153.44 52.64,161.69 53.15,162.2 H1#29.2 ; v1(38.55,120.09) 33.7,120.09 32.26,118.64 v2(19.69,118.64) ; v1(115.39,120.09) 110.53,120.09 109.09,118.64 v2(96.52,118.64) ; v1(153.8,23.72) 148.95,23.72 147.51,22.27 v2(134.93,22.27) ; v2(134.93,86.52) 147.51,86.52 148.95,87.96 v1(153.8,87.96) ; v2(134.93,150.77) 147.51,150.77 148.95,152.21 v1(153.8,152.21) ; v1(115.39,248.59) 110.53,248.59 109.09,247.14 v2(96.52,247.14) ; v1(130.11,217.01) 130.11,217.05 129.47,217.68 129.47,225.94 129.98,226.45 H1#12.2 ; v2(19.69,86.52) 32.26,86.52 33.7,87.96 v1(38.55,87.96) ; v2(134.93,247.14) 147.51,247.14 148.95,248.59 v1(153.8,248.59) ; v1(14.86,217.01) 14.86,217.05 14.22,217.68 14.22,225.94 14.73,226.45 H1#21.2 ; v1(130.11,24.26) 130.11,24.3 129.47,24.94 129.47,33.19 129.98,33.7 H1#9.2 ; H1#18.2 14.73,97.95 14.22,97.44 14.22,89.19 14.86,88.55 v1(14.86,88.51) ; v1(91.69,24.26) 91.69,24.3 91.06,24.94 91.06,33.19 91.56,33.7 H1#2.2 ; v1(91.69,217.01) 91.69,217.05 91.06,217.68 91.06,225.94 91.56,226.45 H1#5.2 ; H1#16.2 14.73,162.2 14.22,161.69 14.22,153.44 14.86,152.8 v1(14.86,152.76) ; H1#17.2 14.73,33.7 14.22,33.19 14.22,24.94 14.86,24.3 v1(14.86,24.26) ; v2(58.1,247.14) 70.67,247.14 72.12,248.59 v1(76.97,248.59) ; H1#15.2 129.98,97.95 129.47,97.44 129.47,89.19 130.11,88.55 v1(130.11,88.51) ; v2(58.1,54.4) 70.67,54.4 72.12,55.84 v1(76.97,55.84) ; v1(14.86,249.13) 14.86,249.17 14.22,249.81 14.22,258.06 14.73,258.57 H1#25.2 ; v1(153.8,184.34) 148.95,184.34 147.51,182.89 v2(134.93,182.89) ; v1(38.55,216.46) 33.7,216.46 32.26,215.02 v2(19.69,215.02) ; H1#22.2 53.15,65.83 52.64,65.32 52.64,57.06 53.28,56.43 v1(53.28,56.39) ; v1(38.55,152.21) 33.7,152.21 32.26,150.77 v2(19.69,150.77) ; v1(53.28,217.01) 53.28,217.05 52.64,217.68 52.64,225.94 53.15,226.45 H1#27.2 ; v1(53.28,184.88) 53.28,184.92 52.64,185.56 52.64,193.81 53.15,194.32 54.55,194.32 ; H1#23.2 53.15,33.7 52.64,33.19 52.64,24.94 53.28,24.3 v1(53.28,24.26) ; v1(76.97,23.72) 72.12,23.72 70.67,22.27 v2(58.1,22.27) ; v1(14.86,184.88) 14.86,184.92 14.22,185.56 14.22,193.81 14.73,194.32 16.13,194.32 ; H1#30.2 53.15,97.95 52.64,97.44 52.64,89.19 53.28,88.55 v1(53.28,88.51) ; v1(76.97,120.09) 72.12,120.09 70.67,118.64 v2(58.1,118.64) ; v2(19.69,182.89) 32.26,182.89 33.7,184.34 v1(38.55,184.34) ; v2(134.93,118.64) 147.51,118.64 148.95,120.09 v1(153.8,120.09)
